# EasyEDA Pro project SuperCapTestBoard - copy - 2 25.eprj

# Schematic Schematic1

## Sheets
1 P1: Create Date: 2024-01-04; Page Name: P1; Project Name: SuperCapTestBoard; Schematic Name: Schematic1; Update Date: 2024-02-14; Company: EasyEDA.com; Drawed: EasyEDA Pro; Page Size: A4; Part Number: JLCPCB-002; Reviewed: EasyEDA Pro; Version: V0.1
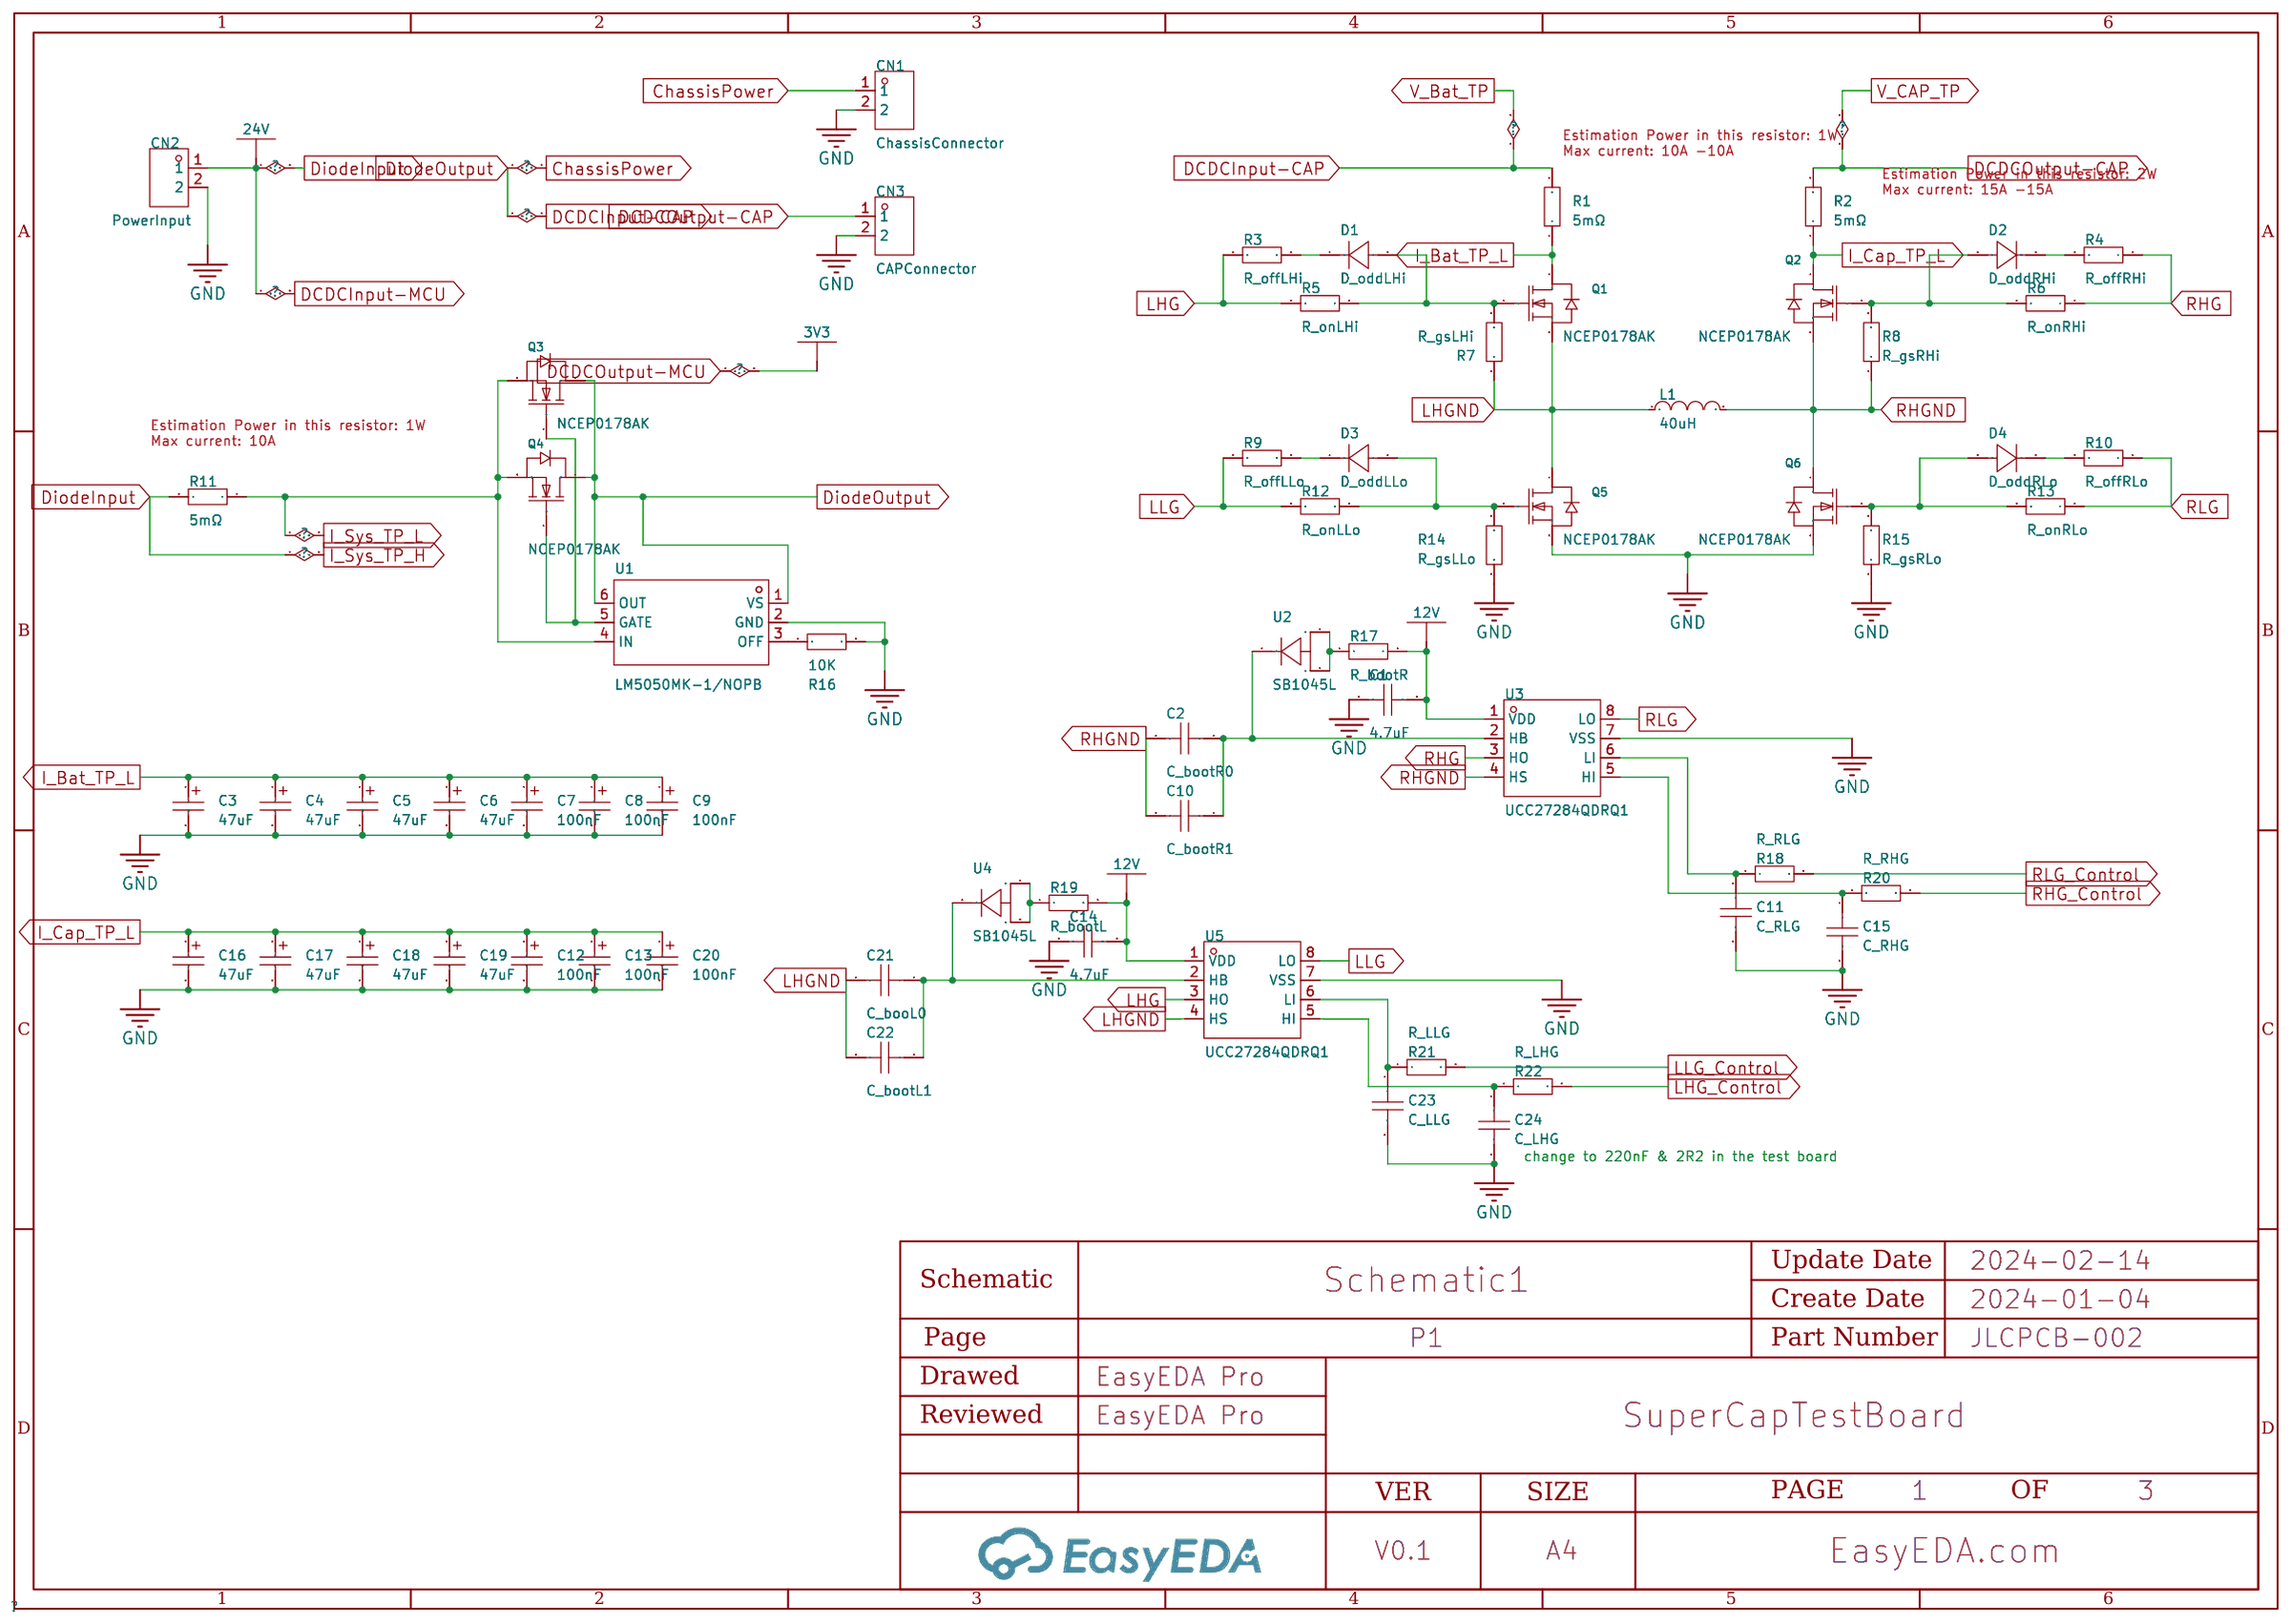
[diagram p0: P1]
2 P2: Create Date: 2024-01-07; Page Name: P2; Update Date: 2024-01-29
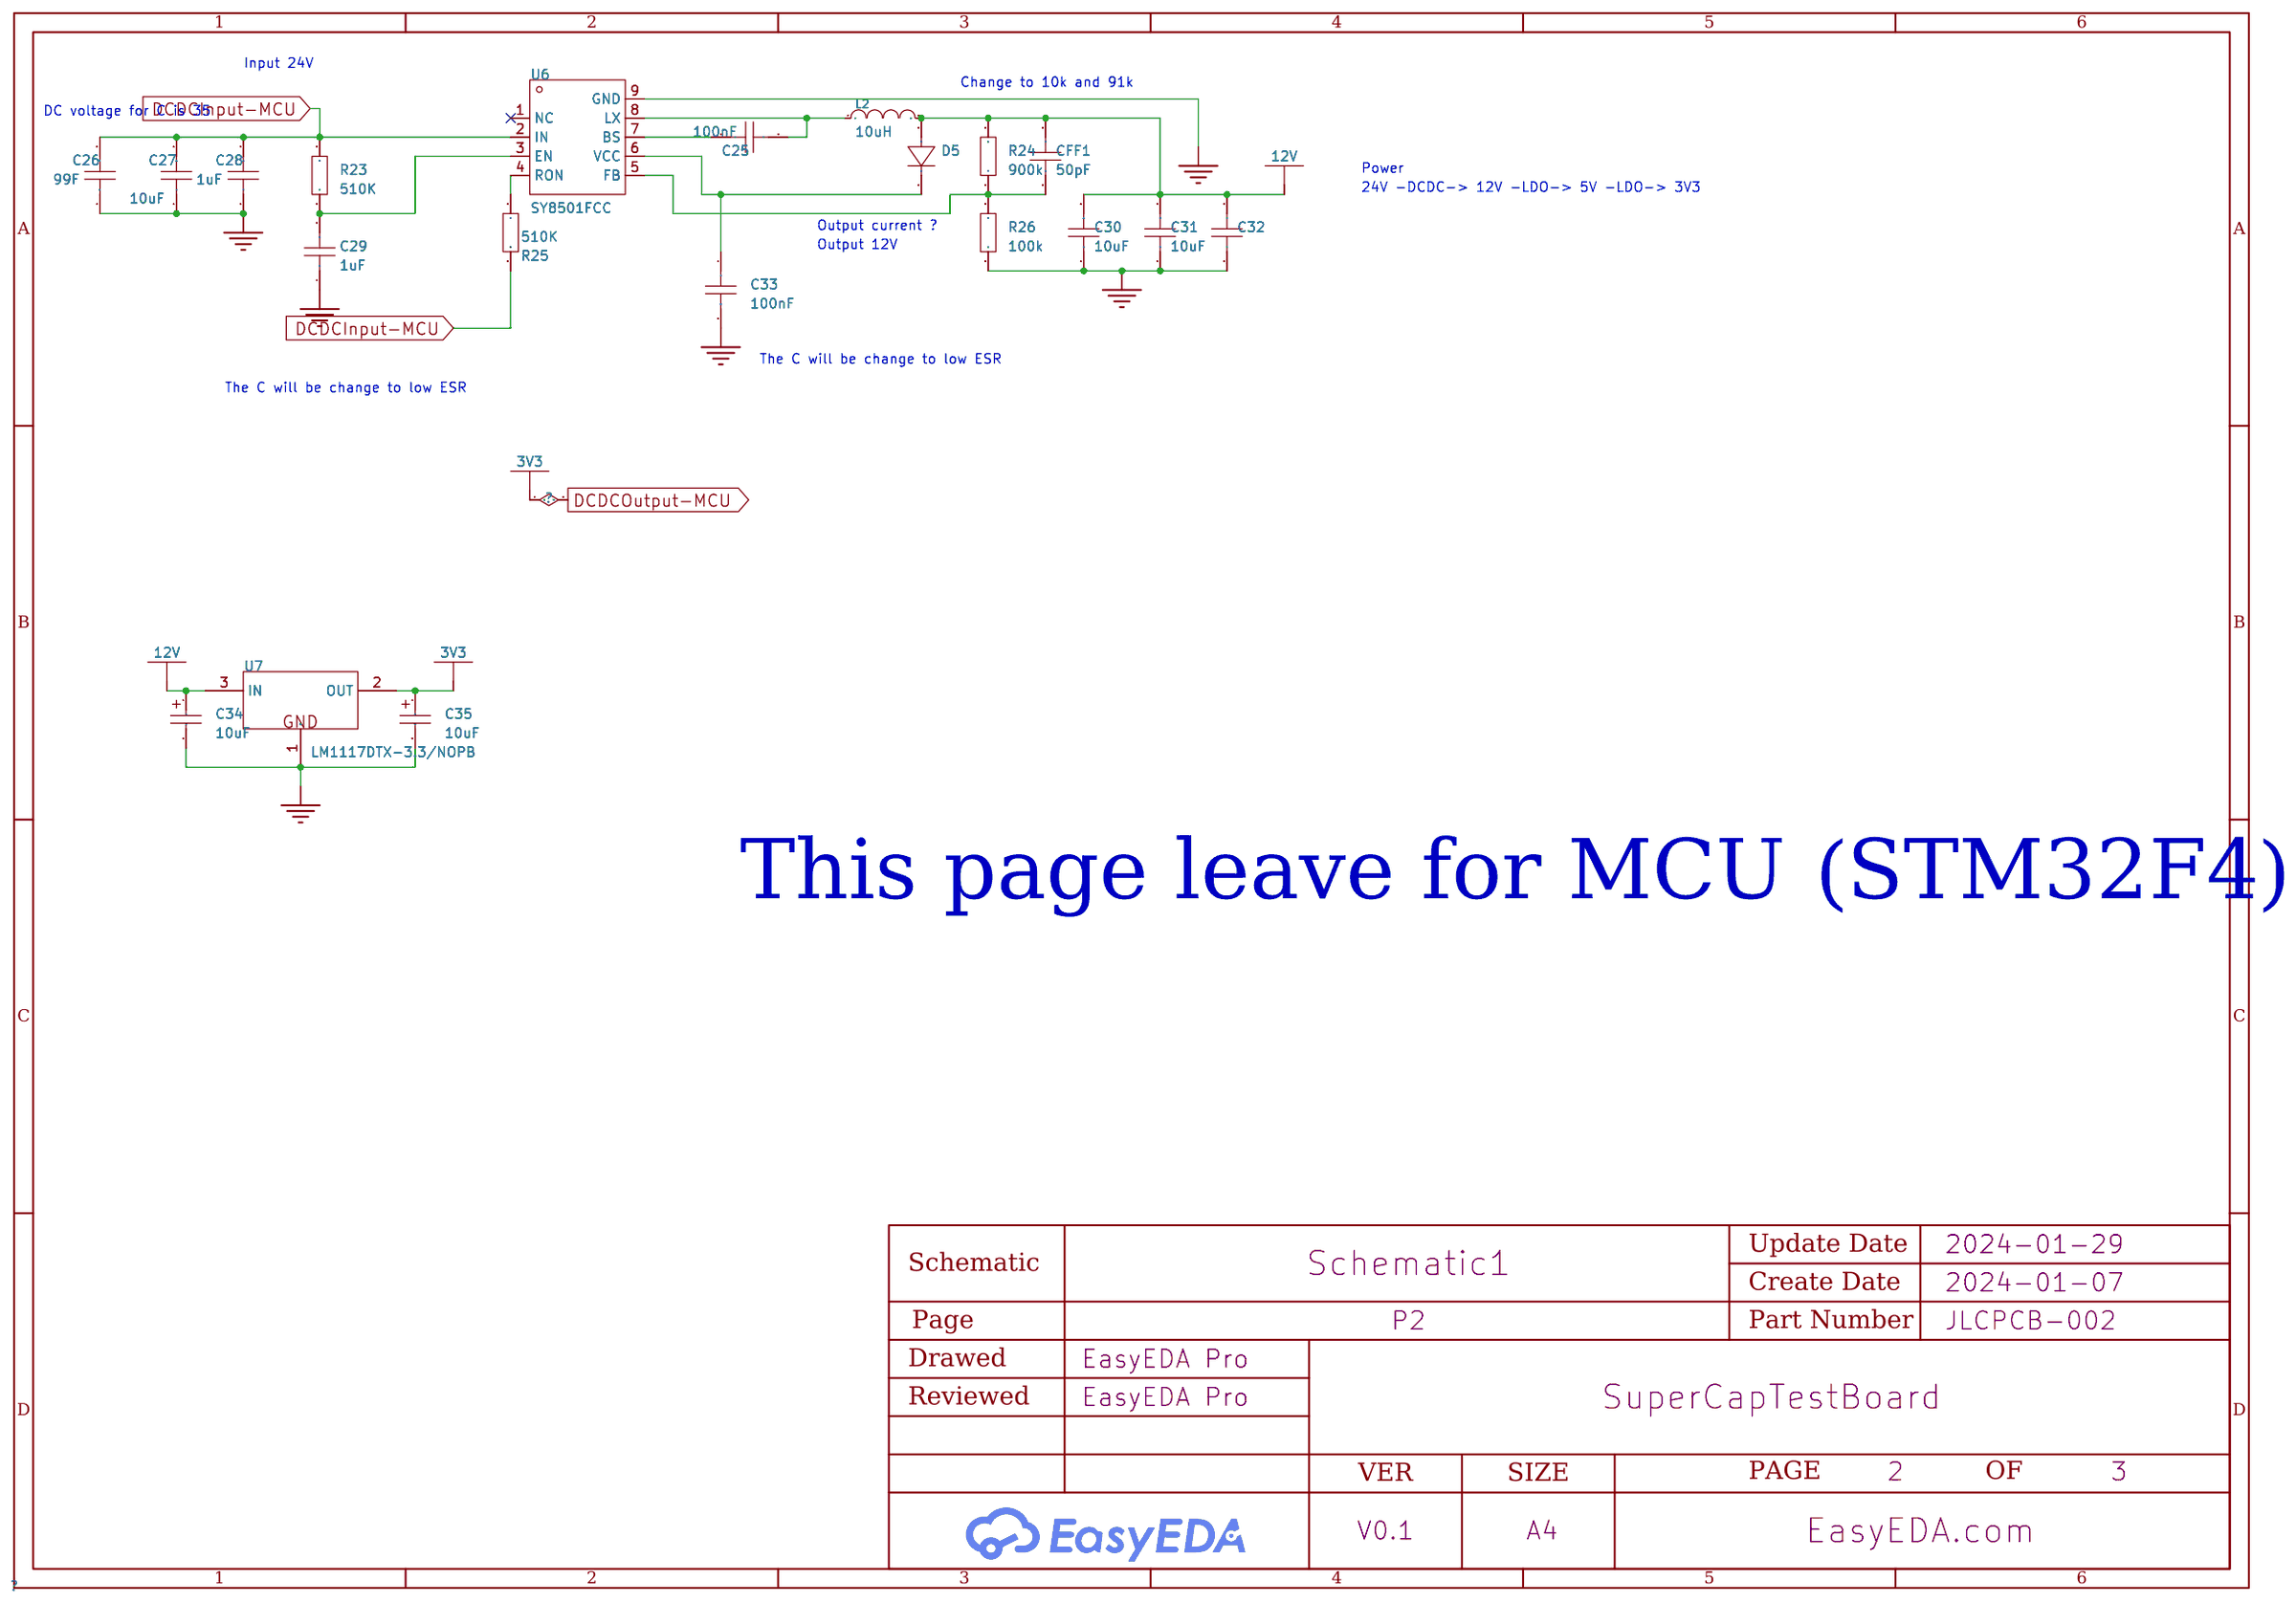
[diagram p1: P2]
3 P3: Create Date: 2024-01-07; Page Name: P3; Update Date: 2024-01-26
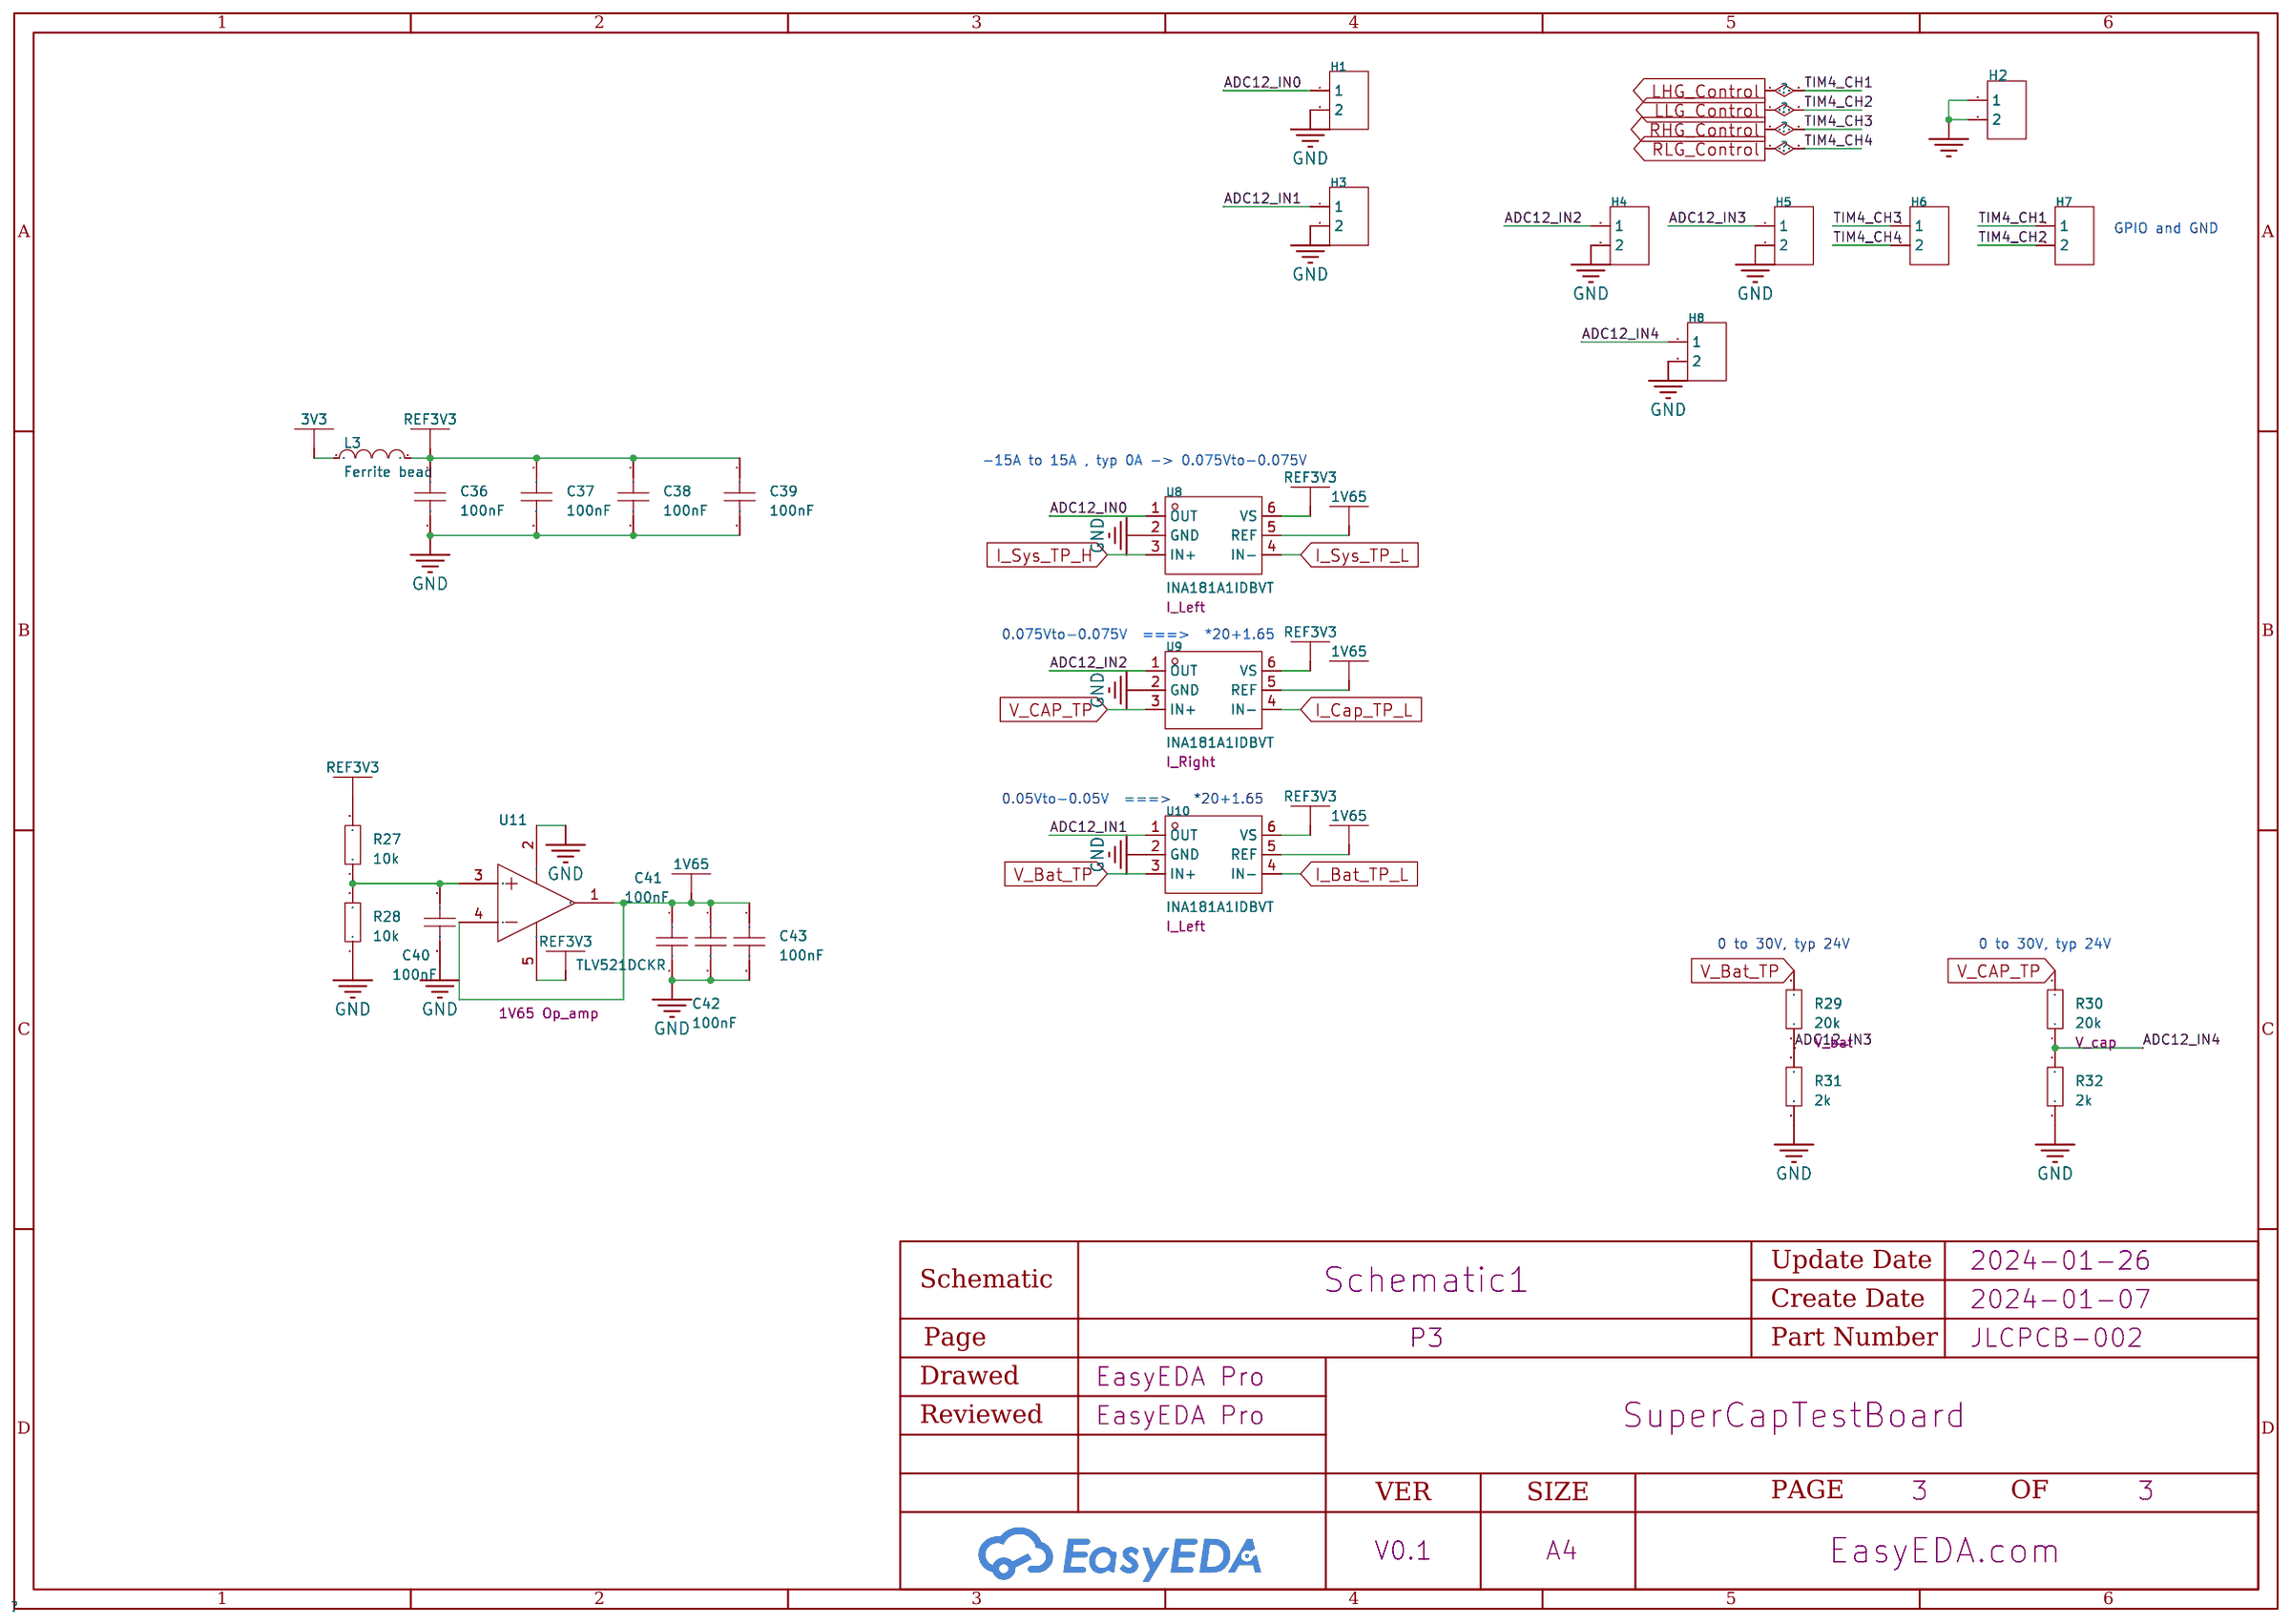
[diagram p2: P3]

## Parts
sheet P1
C1  4.7uF  [C0603]
C2  220nF  [C0603]
C3  47uF  [CAP-SMD_BD6.3-L6.6-W6.6-LS7.2-FD-1]
C4  47uF  [CAP-SMD_BD6.3-L6.6-W6.6-LS7.2-FD-1]
C5  47uF  [CAP-SMD_BD6.3-L6.6-W6.6-LS7.2-FD-1]
C6  47uF  [CAP-SMD_BD6.3-L6.6-W6.6-LS7.2-FD-1]
C7  100nF  [CAP-SMD_BD6.3-L6.6-W6.6-LS7.2-FD-1]
C8  100nF  [CAP-SMD_BD6.3-L6.6-W6.6-LS7.2-FD-1]
C9  100nF  [CAP-SMD_BD6.3-L6.6-W6.6-LS7.2-FD-1]
C10  220nF  [C0603]
C11  100nF  [C0603]
C12  100nF  [CAP-SMD_BD6.3-L6.6-W6.6-LS7.2-FD-1]
C13  100nF  [CAP-SMD_BD6.3-L6.6-W6.6-LS7.2-FD-1]
C14  4.7uF  [C0603]
C15  100nF  [C0603]
C16  47uF  [CAP-SMD_BD6.3-L6.6-W6.6-LS7.2-FD-1]
C17  47uF  [CAP-SMD_BD6.3-L6.6-W6.6-LS7.2-FD-1]
C18  47uF  [CAP-SMD_BD6.3-L6.6-W6.6-LS7.2-FD-1]
C19  47uF  [CAP-SMD_BD6.3-L6.6-W6.6-LS7.2-FD-1]
C20  100nF  [CAP-SMD_BD6.3-L6.6-W6.6-LS7.2-FD-1]
C21  220nF  [C0603]
C22  220nF  [C0603]
C23  100nF  [C0603]
C24  100nF  [C0603]
CN1  ChassisConnector  [CONN-TH_XT30U-M]
CN2  PowerInput  [CONN-TH_XT30U-M]
CN3  CAPConnector  [CONN-TH_XT30U-M]
D1  D_oddLHi  [DO-214AC_L4.3-W2.4-LS4.7-RD]
D2  D_oddRHi  [DO-214AC_L4.3-W2.4-LS4.7-RD]
D3  D_oddLLo  [DO-214AC_L4.3-W2.4-LS4.7-RD]
D4  D_oddRLo  [DO-214AC_L4.3-W2.4-LS4.7-RD]
L1  40uH  [Inductor 080125]
Q1  NCEP0178AK  [TO-252-2_L6.5-W6.1-P4.58-LS10.0-TL]
Q2  NCEP0178AK  [TO-252-2_L6.5-W6.1-P4.58-LS10.0-TL]
Q3  NCEP0178AK  [TO-252-2_L6.5-W6.1-P4.58-LS10.0-TL]
Q4  NCEP0178AK  [TO-252-2_L6.5-W6.1-P4.58-LS10.0-TL]
Q5  NCEP0178AK  [TO-252-2_L6.5-W6.1-P4.58-LS10.0-TL]
Q6  NCEP0178AK  [TO-252-2_L6.5-W6.1-P4.58-LS10.0-TL]
R1  5mΩ  [R2512]
R2  5mΩ  [R2512]
R3  2.2  [R0603]
R4  2.2  [R0603]
R5  2.2  [R0603]
R6  2.2  [R0603]
R7  10K  [R0603]
R8  10K  [R0603]
R9  2.2  [R0603]
R10  2.2  [R0603]
R11  5mΩ  [R2512]
R12  2.2  [R0603]
R13  2.2  [R0603]
R14  10K  [R0603]
R15  10K  [R0603]
R16  10K  [R0603]
R17  2.2  [R0805_NEW]
R18  10  [R0603]
R19  2.2  [R0805_NEW]
R20  10  [R0603]
R21  10  [R0603]
R22  10  [R0603]
U1  LM5050MK-1/NOPB  [TSOT-23-6_L2.9-W1.6-P0.95-LS2.8-BR]
U2  SB1045L  [TO-277_3P-L5.4-W4.0-LS6.5-TR]
U3  UCC27284QDRQ1  [SOIC-8_L4.9-W3.9-P1.27-LS6.0-BL]
U4  SB1045L  [TO-277_3P-L5.4-W4.0-LS6.5-TR]
U5  UCC27284QDRQ1  [SOIC-8_L4.9-W3.9-P1.27-LS6.0-BL]
sheet P2
C25  100nF  [C0603]
C26  99F  [R0805_NEW]
C27  10uF  [R0805_NEW]
C28  1uF  [R0805_NEW]
C29  1uF  [C0603]
C30  10uF  [R0805_NEW]
C31  10uF  [R0805_NEW]
C32  10uF  [R0805_NEW]
C33  100nF  [C0603]
C34  10uF  [CAP-SMD_L3.2-W1.6-RD-C7171]
C35  10uF  [CAP-SMD_L3.2-W1.6-RD-C7171]
CFF1  50pF  [R0805_NEW]
D5  -  [do-214ac_l4.3-w2.7-ls5.2-rd]
L2  10uH  [ind-smd_l7.0-w6.6_cmkd-0630a]
R23  510K  [R0603]
R24  900k  [R0603]
R25  510K  [R0603]
R26  100k  [R0603]
U6  SY8501FCC  [SO-8_L4.9-W3.9-P1.27-LS6.0-BL-EP]
U7  LM1117DTX-3.3/NOPB  [TO-252-2_L6.6-W6.1-P4.57-LS9.9-BR-CW]
sheet P3
C36  100nF  [C0603]
C37  100nF  [C0603]
C38  100nF  [C0603]
C39  100nF  [C0603]
C40  100nF  [C0603]
C41  100nF  [C0603]
C42  100nF  [C0603]
C43  100nF  [C0603]
H1  -  [HDR-TH_2P-P2.54-V-F]
H2  -  [HDR-TH_2P-P2.54-V-F]
H3  -  [HDR-TH_2P-P2.54-V-F]
H4  -  [HDR-TH_2P-P2.54-V-F]
H5  -  [HDR-TH_2P-P2.54-V-F]
H6  -  [HDR-TH_2P-P2.54-V-F]
H7  -  [HDR-TH_2P-P2.54-V-F]
H8  -  [HDR-TH_2P-P2.54-V-F]
L3  10uH  [L0805]
R27  10k  [R0603]
R28  10k  [R0603]
R29  20k  [R0603]
R30  20k  [R0603]
R31  2k  [R0603]
R32  2k  [R0603]
U8  INA181A1IDBVT  [SOT-23-6_L2.9-W1.6-P0.95-LS2.8-BL]
U9  INA181A1IDBVT  [SOT-23-6_L2.9-W1.6-P0.95-LS2.8-BL]
U10  INA181A1IDBVT  [SOT-23-6_L2.9-W1.6-P0.95-LS2.8-BL]
U11  TLV521DCKR  [SC-70-5_L2.1-W1.3-P0.65-LS2.1-BR]